# EasyEDA Pro project 3SE_24_Power_Rune.eprj, board Armour_Demo1.0
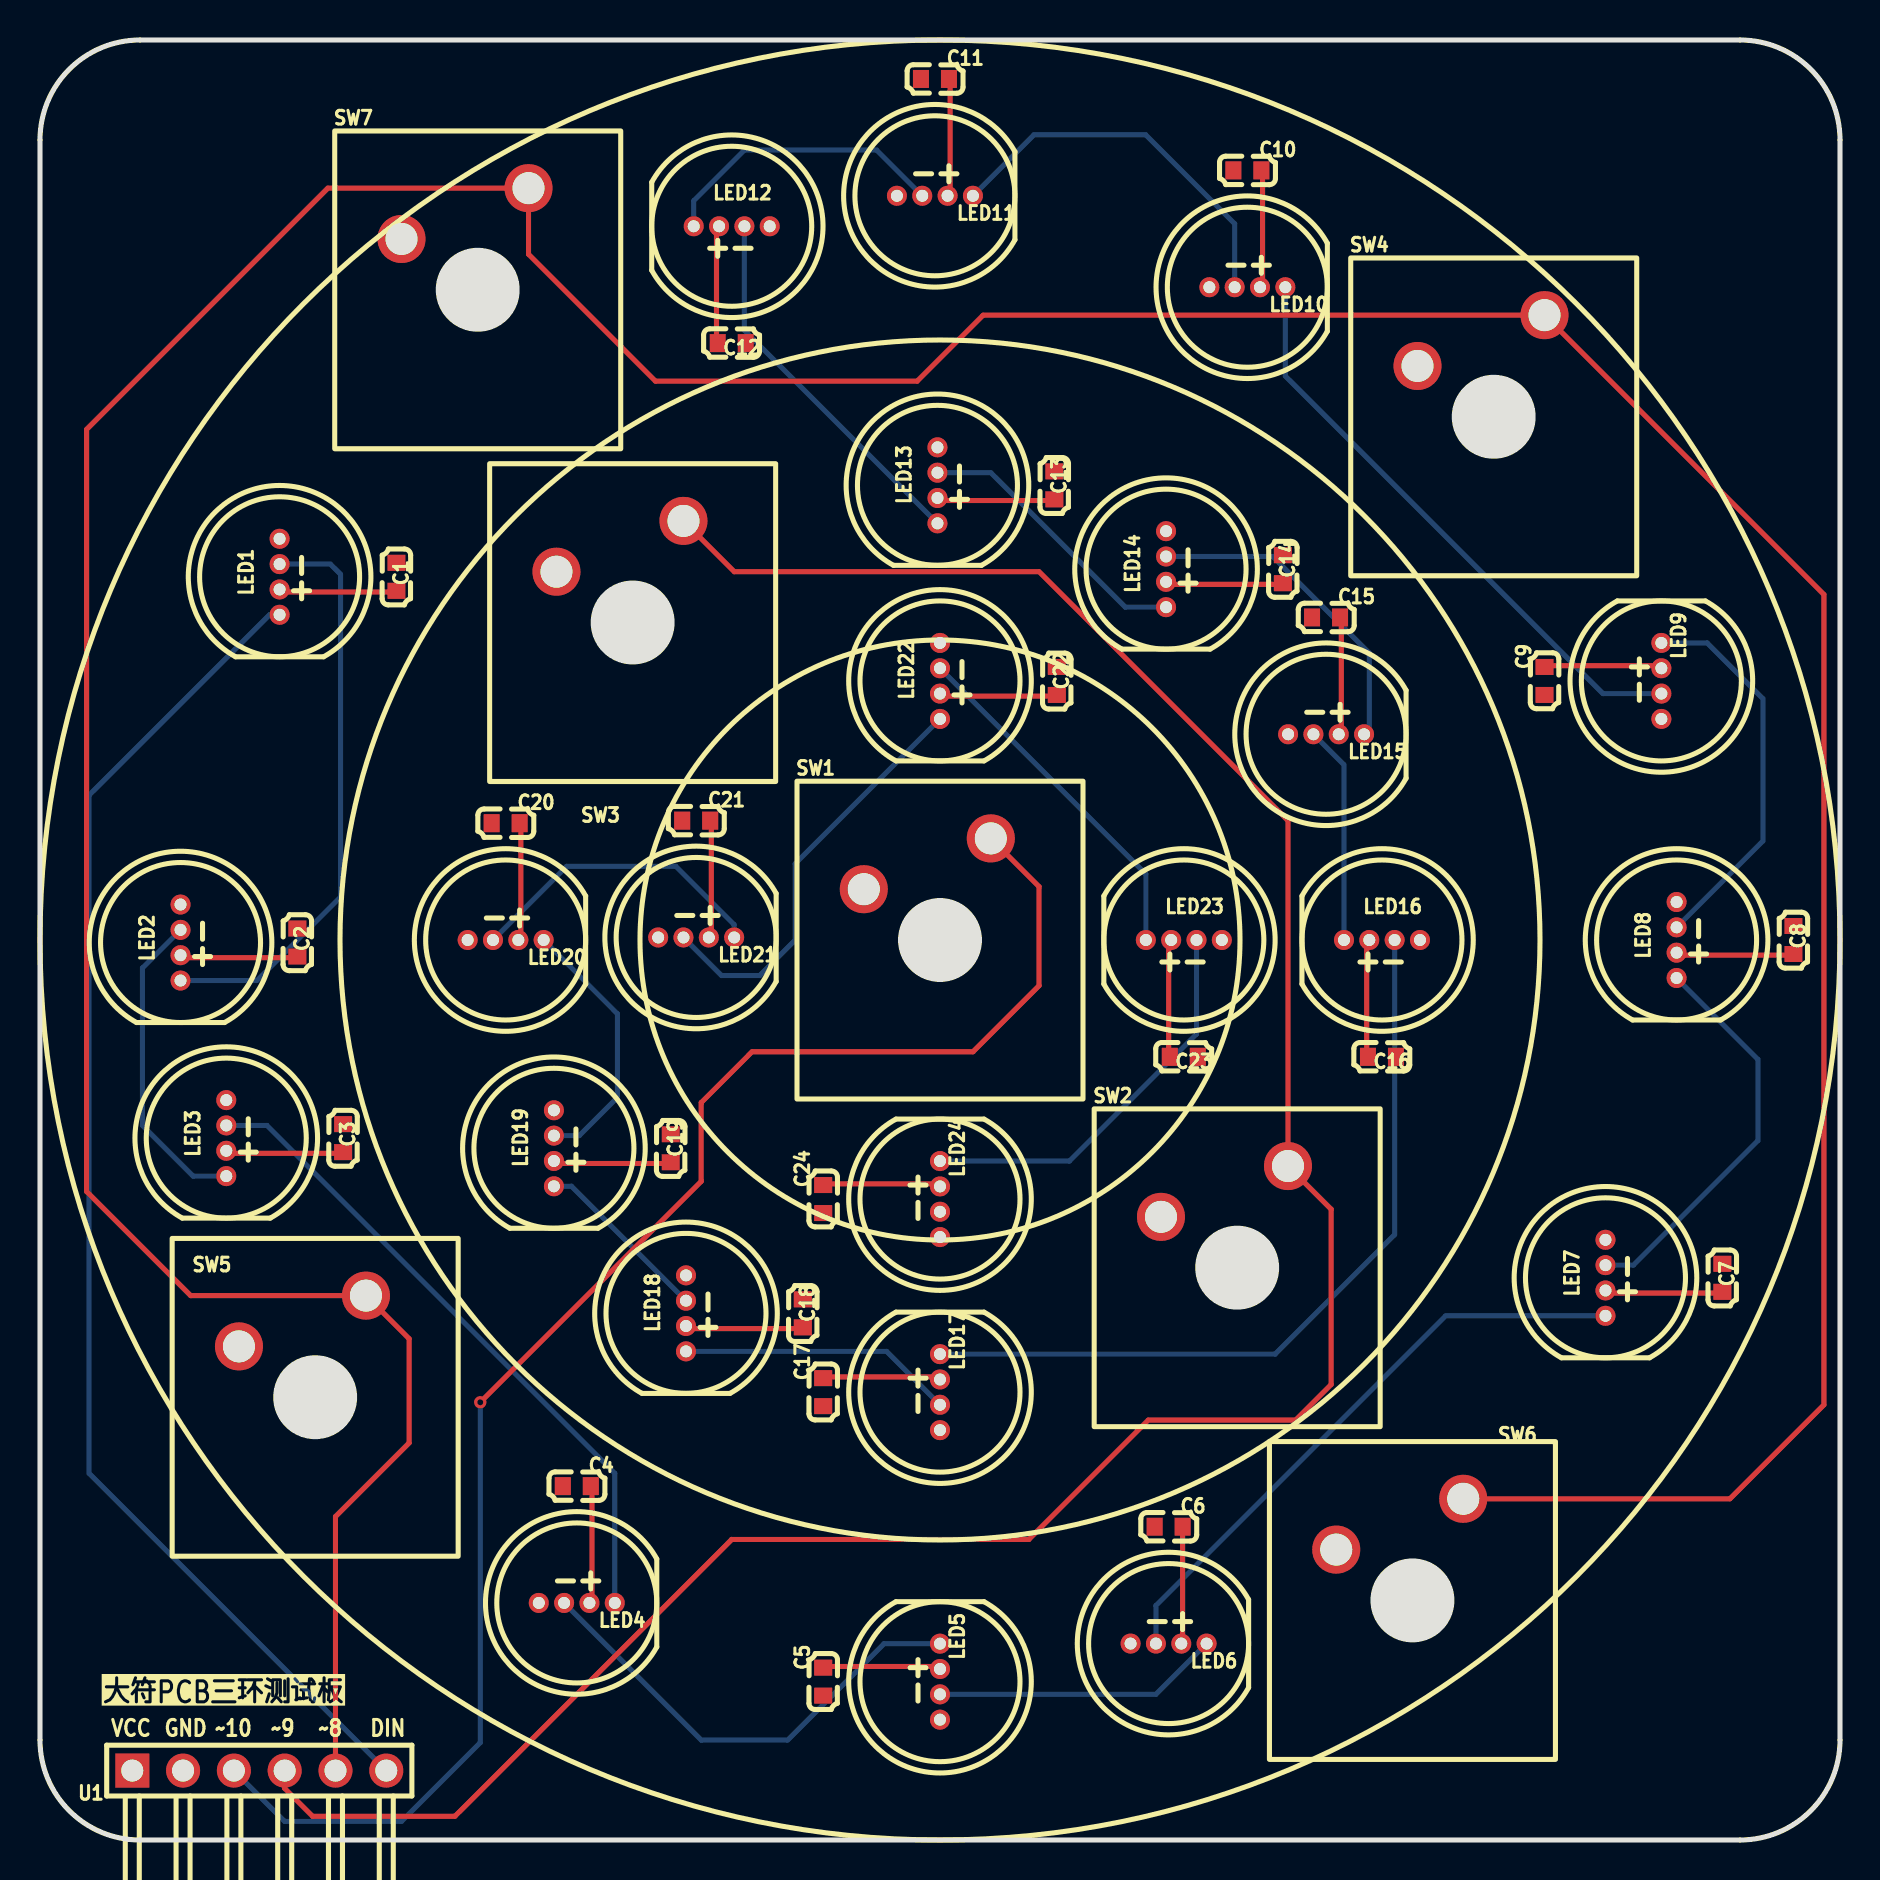
[diagram p7: board, top side]
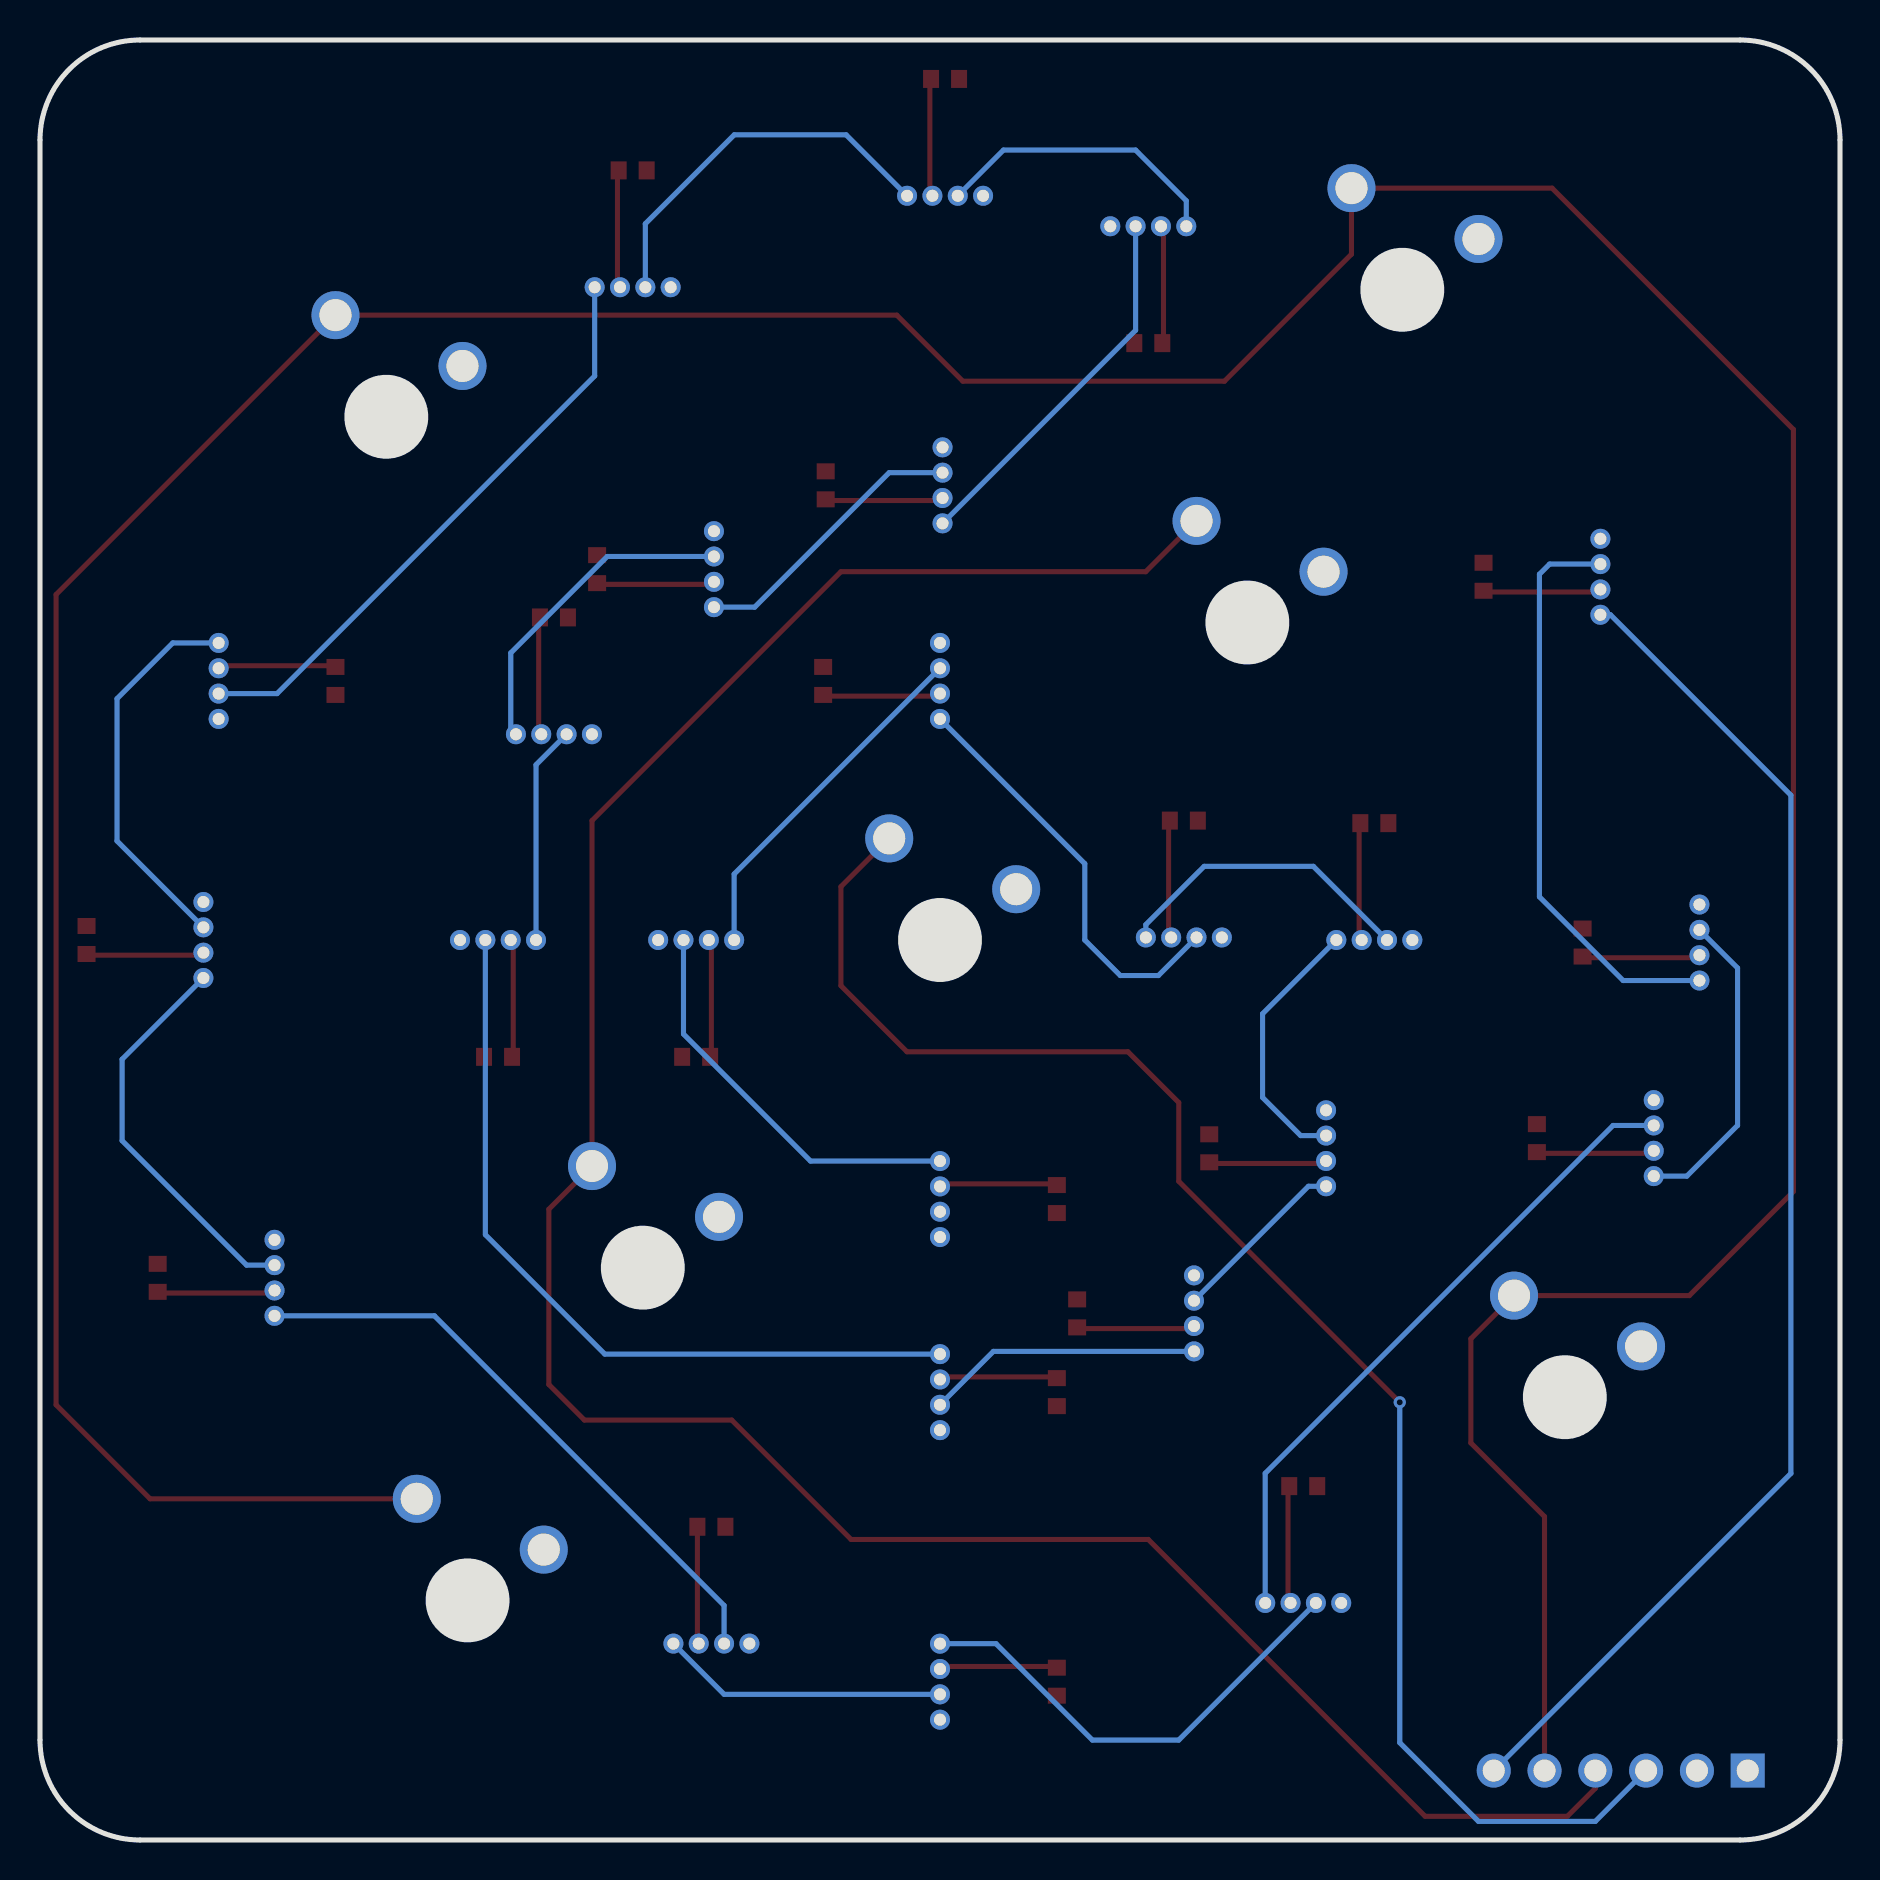
[diagram p8: board, bottom side, seen from below]

Outline 90 x 90 mm; copper layers: Top Layer, Bottom Layer. Coordinates in mm from the lower left corner of the outline.
Outline path: 0,85 0,5 arc(1.46,1.46) 5,0 85,0 arc(88.54,1.46) 90,5 90,85 arc(88.54,88.54) 85,90 5,90 arc(1.46,88.54) 0,85
Stack: Top Layer 0.035mm / Dielectric1 1.51mm FR4 er 4.5 / Bottom Layer 0.035mm

## Design rules (mm)
template: 自定义配置
spacing copperThickness1oz (default): track to track 0.102, other pairs 0.152 to 0.3
spacing copperThickness2oz: track to track 0.203, other pairs 0.152 to 0.3
track width copperThickness1oz (default): min 0.127, default 0.254, max 2.54
track width copperThickness2oz: min 0.203, default 0.254, max 2.54
differential pair differentialPair (default): width min 0.127, default 0.254, max 2.54; gap min 0.152, default 0.152
via viaSize (default): diameter min 0.5, default 0.61, max 10; hole min 0.3, default 0.305, max 6.3
net GND uses power
net VCC uses power

## Placement (name value [footprint] x y rotation side)
C1  -  [C0603]  17.82 63.16 90 top
C2  -  [C0603]  12.87 44.87 90 top
C3  -  [C0603]  15.16 35.09 90 top
C4  -  [C0603]  26.84 17.69 180 top
C5  -  [C0603]  39.16 7.92 270 top
C6  -  [C0603]  56.43 15.66 180 top
C7  -  [C0603]  84.12 28.11 90 top
C8  -  [C0603]  87.67 45 90 top
C9  -  [C0603]  75.23 57.95 270 top
C10  -  [C0603]  60.37 83.48 180 top
C11  -  [C0603]  44.75 88.05 180 top
C12  -  [C0603]  34.59 74.84 0 top
C13  -  [C0603]  50.72 67.73 90 top
C14  -  [C0603]  62.15 63.54 90 top
C15  -  [C0603]  64.3 61.13 180 top
C16  -  [C0603]  67.1 39.16 0 top
C17  -  [C0603]  39.16 22.39 270 top
C18  -  [C0603]  38.14 26.33 90 top
C19  -  [C0603]  31.54 34.59 90 top
C20  -  [C0603]  23.28 50.84 180 top
C21  100nF  [C0603]  32.81 50.97 180 top
C22  100nF  [C0603]  50.84 57.95 90 top
C23  100nF  [C0603]  57.19 39.16 0 top
C24  100nF  [C0603]  39.16 32.05 270 top
LED1  -  [LED-TH_WS2812D-F8]  11.98 63.16 90 top
LED2  -  [LED-TH_WS2812D-F8]  7.03 44.87 90 top
LED3  -  [LED-TH_WS2812D-F8]  9.31 35.09 90 top
LED4  -  [LED-TH_WS2812D-F8]  26.84 11.85 180 top
LED5  -  [LED-TH_WS2812D-F8]  45 7.92 270 top
LED6  -  [LED-TH_WS2812D-F8]  56.43 9.82 180 top
LED7  -  [LED-TH_WS2812D-F8]  78.27 28.11 90 top
LED8  -  [LED-TH_WS2812D-F8]  81.83 45 90 top
LED9  -  [LED-TH_WS2812D-F8]  81.07 57.95 270 top
LED10  -  [LED-TH_WS2812D-F8]  60.37 77.64 180 top
LED11  -  [LED-TH_WS2812D-F8]  44.75 82.21 180 top
LED12  -  [LED-TH_WS2812D-F8]  34.59 80.69 0 top
LED13  -  [LED-TH_WS2812D-F8]  44.87 67.73 90 top
LED14  -  [LED-TH_WS2812D-F8]  56.3 63.54 90 top
LED15  -  [LED-TH_WS2812D-F8]  64.3 55.29 180 top
LED16  -  [LED-TH_WS2812D-F8]  67.1 45 0 top
LED17  -  [LED-TH_WS2812D-F8]  45 22.39 270 top
LED18  -  [LED-TH_WS2812D-F8]  32.3 26.33 90 top
LED19  -  [LED-TH_WS2812D-F8]  25.7 34.59 90 top
LED20  -  [LED-TH_WS2812D-F8]  23.28 45 180 top
LED21  WS2812D-F8  [LED-TH_WS2812D-F8]  32.81 45.13 180 top
LED22  WS2812D-F8  [LED-TH_WS2812D-F8]  45 57.95 90 top
LED23  WS2812D-F8  [LED-TH_WS2812D-F8]  57.19 45 0 top
LED24  -  [LED-TH_WS2812D-F8]  45 32.05 270 top
SW1  -  [SW-TH_CPG151101D9X]  44.37 48.81 0 top
SW2  -  [SW-TH_CPG151101D9X]  59.22 32.43 0 top
SW3  -  [SW-TH_CPG151101D9X]  29 64.69 0 top
SW4  -  [SW-TH_CPG151101D9X]  72.05 74.97 0 top
SW5  -  [SW-TH_CPG151101D9X]  13.12 25.95 0 top
SW6  -  [SW-TH_CPG151101D9X]  67.99 15.79 0 top
SW7  -  [SW-TH_CPG151101D9X]  21.25 81.32 0 top
U1  -  [HDR-TH_6P-P2.54-H-M-W7.7-P]  10.96 3.47 0 top

## Footprints (pads in the part's own frame, mm; a bottom-side part is the same pattern mirrored in y, then rotated)
C0603
  rect 0.8x0.9 smd: 1(-0.7,0) 2(0.7,0)
HDR-TH_6P-P2.54-H-M-W7.7-P
  rect 1.7x1.7 hole 1.1: 1(-6.35,0)
  round 1.7 hole 1.1: 2(-3.81,0) 3(-1.27,0) 4(1.27,0) 5(3.81,0) 6(6.35,0)
LED-TH_WS2812D-F8
  round 1 hole 0.6: 1(-1.9,0) 2(-0.633,0) 3(0.633,0) 4(1.9,0)
SW-TH_CPG151101D9X
  round 2.4 hole 1.6: 1(-3.175,-1.27) 2(3.175,1.27)

## Nets
GND: C1.2 C2.2 C3.2 C4.2 C5.2 C6.2 C7.2 C8.2 C9.2 C10.2 C11.2 C12.2 C13.2 C14.2 C15.2 C16.2 C17.2 C18.2 C19.2 C20.2 C21.2 C22.2 C23.2 C24.2 LED1.4 LED2.4 LED3.4 LED4.4 LED5.4 LED6.4 LED7.4 LED8.4 LED9.4 LED10.4 LED11.4 LED12.4 LED13.4 LED14.4 LED15.4 LED16.4 LED17.4 LED18.4 LED19.4 LED20.4 LED21.4 LED22.4 LED23.4 LED24.4 SW1.1 SW2.1 SW3.1 SW4.1 SW5.1 SW6.1 SW7.1 U1.2
VCC: C1.1 C2.1 C3.1 C4.1 C5.1 C6.1 C7.1 C8.1 C9.1 C10.1 C11.1 C12.1 C13.1 C14.1 C15.1 C16.1 C17.1 C18.1 C19.1 C20.1 C21.1 C22.1 C23.1 C24.1 LED1.2 LED2.2 LED3.2 LED4.2 LED5.2 LED6.2 LED7.2 LED8.2 LED9.2 LED10.2 LED11.2 LED12.2 LED13.2 LED14.2 LED15.2 LED16.2 LED17.2 LED18.2 LED19.2 LED20.2 LED21.2 LED22.2 LED23.2 LED24.2 U1.1
$1I5321/DOUT: LED24.3
DIN: LED1.1 U1.6
KEY8: SW4.2 SW5.2 SW6.2 SW7.2 U1.5
KEY9: SW2.2 SW3.2 U1.4
KEY10: SW1.2 U1.3
$1N4572: LED17.3 LED18.1
$1N4574: LED16.3 LED17.1
$1N4576: LED15.3 LED16.1
$1N4578: LED14.3 LED15.1
$1N4580: LED13.3 LED14.1
$1N4582: LED12.3 LED13.1
$1N4584: LED11.3 LED12.1
$1N4586: LED10.3 LED11.1
$1N4588: LED9.3 LED10.1
$1N4592: LED7.3 LED8.1
$1N4594: LED6.3 LED7.1
$1N4596: LED5.3 LED6.1
$1N4598: LED4.3 LED5.1
$1N4600: LED3.3 LED4.1
$1N4602: LED2.3 LED3.1
$1N4604: LED1.3 LED2.1
$1N5085: LED18.3 LED19.1
$1N5201: LED8.3 LED9.1
$1N5279: LED19.3 LED20.1
$1N5305: LED21.3 LED22.1
$1N5319: LED22.3 LED23.1
$1N5333: LED23.3 LED24.1
$1N5366: LED20.3 LED21.1

## Via types
v1: diameter 0.61, hole 0.305, Top Layer to Bottom Layer, 1 via

## Routing (per net, layer and track width the routed paths; a pad name or vN(x,y) marks a point on that pad's centre or on a via; arc(x,y) is an arc through that point)
VCC: length 141.6
  Top Layer w0.254: 50.78,57.19 44.87,57.19 ; 45.13,23.15 39.22,23.15 ; LED6.2 57.13,9.89 C6.1 ; 45.13,8.68 39.22,8.68 ; 33.83,80.81 33.83,74.91 ; 50.65,66.97 44.75,66.97 ; 32.17,25.57 38.08,25.57 ; 75.29,58.71 81.19,58.71 ; 84.05,27.35 78.15,27.35 ; 56.43,39.22 56.43,45.13 ; 56.18,62.78 62.08,62.78 ; 9.19,34.33 15.09,34.33 ; 45.51,82.08 45.51,87.99 ; 87.61,44.24 81.7,44.24 ; 11.85,62.4 17.76,62.4 ; 6.9,44.11 12.8,44.11 ; 31.47,33.83 25.57,33.83 ; 39.22,32.81 45.13,32.81 ; 61.13,77.51 61.13,83.41 ; 66.34,39.22 66.34,45.13 ; 27.6,11.73 27.6,17.63 ; 33.57,50.9 33.57,45 ; 65.06,61.06 65.06,55.16 ; 24.04,50.78 24.04,44.87
DIN: length 68.2
  Bottom Layer w0.254: U1.6 2.45,18.33 2.45,52.24 11.48,61.26 LED1.1
KEY8: length 245.8
  Top Layer w0.254: SW6.2 84.5,17.06 89.2,21.76 89.2,62.27 SW4.2 47.16,76.24 43.86,72.94 30.78,72.94 24.43,79.29 SW7.2 14.39,82.59 2.33,70.53 2.33,32.43 7.53,27.22 SW5.2 18.46,25.06 18.46,19.85 14.77,16.17 U1.5
KEY9: length 128.3
  Top Layer w0.254: U1.4 12.23,2.58 13.63,1.19 20.74,1.19 34.59,15.03 49.44,15.03 55.41,21 62.78,21 64.56,22.78 64.56,31.54 SW2.2 62.4,50.97 49.95,63.42 34.71,63.42 SW3.2
KEY10: length 79.1
  Top Layer w0.254: SW1.2 49.95,47.67 49.95,42.71 46.65,39.41 35.6,39.41 33.06,36.87 33.06,32.94 22.14,22.01
  Bottom Layer w0.254: U1.3 12.23,0.93 18.08,0.93 22.01,4.87 v1(22.01,21.89)
$1N4572: length 13.8
  Bottom Layer w0.254: LED17.3 42.33,24.43 32.3,24.43
$1N4574: length 39.9
  Bottom Layer w0.254: LED16.3 67.73,30.27 61.76,24.29 LED17.1
$1N4576: length 10.9
  Bottom Layer w0.254: LED15.3 65.2,53.76 LED16.1
$1N4578: length 16.3
  Bottom Layer w0.254: LED14.3 61.64,64.18 66.46,59.35 66.46,55.55 LED15.1
$1N4580: length 14.2
  Bottom Layer w0.254: LED14.1 54.27,61.64 47.54,68.37 LED13.3
$1N4582: length 18.9
  Bottom Layer w0.254: LED12.3 35.22,75.49 LED13.1
$1N4584: length 14.7
  Bottom Layer w0.254: LED11.3 41.83,84.5 35.22,84.5 32.69,81.96 LED12.1
$1N4586: length 19.4
  Bottom Layer w0.254: LED11.1 49.69,85.26 55.29,85.26 59.73,80.81 LED10.3
$1N4588: length 29.8
  Bottom Layer w0.254: LED10.1 62.27,73.2 78.15,57.32 LED9.3
$1N4592: length 20
  Bottom Layer w0.254: LED7.3 79.67,28.74 85.89,34.97 85.89,39.04 LED8.1
$1N4594: length 30.4
  Bottom Layer w0.254: LED7.1 70.28,26.21 55.8,11.73 LED6.3
$1N4596: length 14.4
  Bottom Layer w0.254: LED5.3 55.79,7.28 LED6.1
$1N4598: length 23.6
  Bottom Layer w0.254: LED4.3 33.06,5 37.38,5 42.2,9.82 LED5.1
$1N4600: length 33.1
  Bottom Layer w0.254: LED4.1 28.74,18.34 11.35,35.73 LED3.3
$1N4602: length 15.8
  Bottom Layer w0.254: LED2.3 5.12,43.6 5.12,35.73 7.66,33.19 LED3.1
$1N4604: length 29.1
  Bottom Layer w0.254: 11.98,63.8 14.52,63.8 15.03,63.29 15.03,47.16 10.84,42.97 LED2.1
$1N5085: length 9
  Bottom Layer w0.254: LED19.1 26.58,32.69 LED18.3
$1N5201: length 19.5
  Bottom Layer w0.254: LED8.3 86.15,49.95 86.15,57.06 83.36,59.85 LED9.1
$1N5279: length 13.4
  Bottom Layer w0.254: LED19.3 26.96,35.22 28.87,37.13 28.87,41.31 LED20.1
$1N5305: length 21.2
  Bottom Layer w0.254: LED22.1 37.76,48.81 37.76,45 35.98,43.22 34.08,43.22 LED21.3
$1N5319: length 17.9
  Bottom Layer w0.254: LED22.3 55.29,48.3 LED23.1
$1N5333: length 20.2
  Bottom Layer w0.254: LED24.1 51.47,33.95 57.83,40.3 LED23.3
$1N5366: length 15.4
  Bottom Layer w0.254: LED21.1 34.71,45.77 31.79,48.68 26.33,48.68 LED20.3

## Copper pours and planes (outline as drawn; the poured copper is in the pictures)
GND on Top Layer: 0.04,90.47 90.59,90.47 90.59,-0.47 0.04,-0.47
VCC on Bottom Layer: -0.47,90.72 90.34,90.72 90.34,-0.97 -0.47,-0.97

## Text on the board
Top Silkscreen Layer: VCC | GND | ~10 | ~9 | ~8 | DIN | 大符PCB三环测试板
